# EasyEDA Pro project BCI_nikki_corp_ver_1.0.eprj, schematic BCI_ADS1299 (continued)
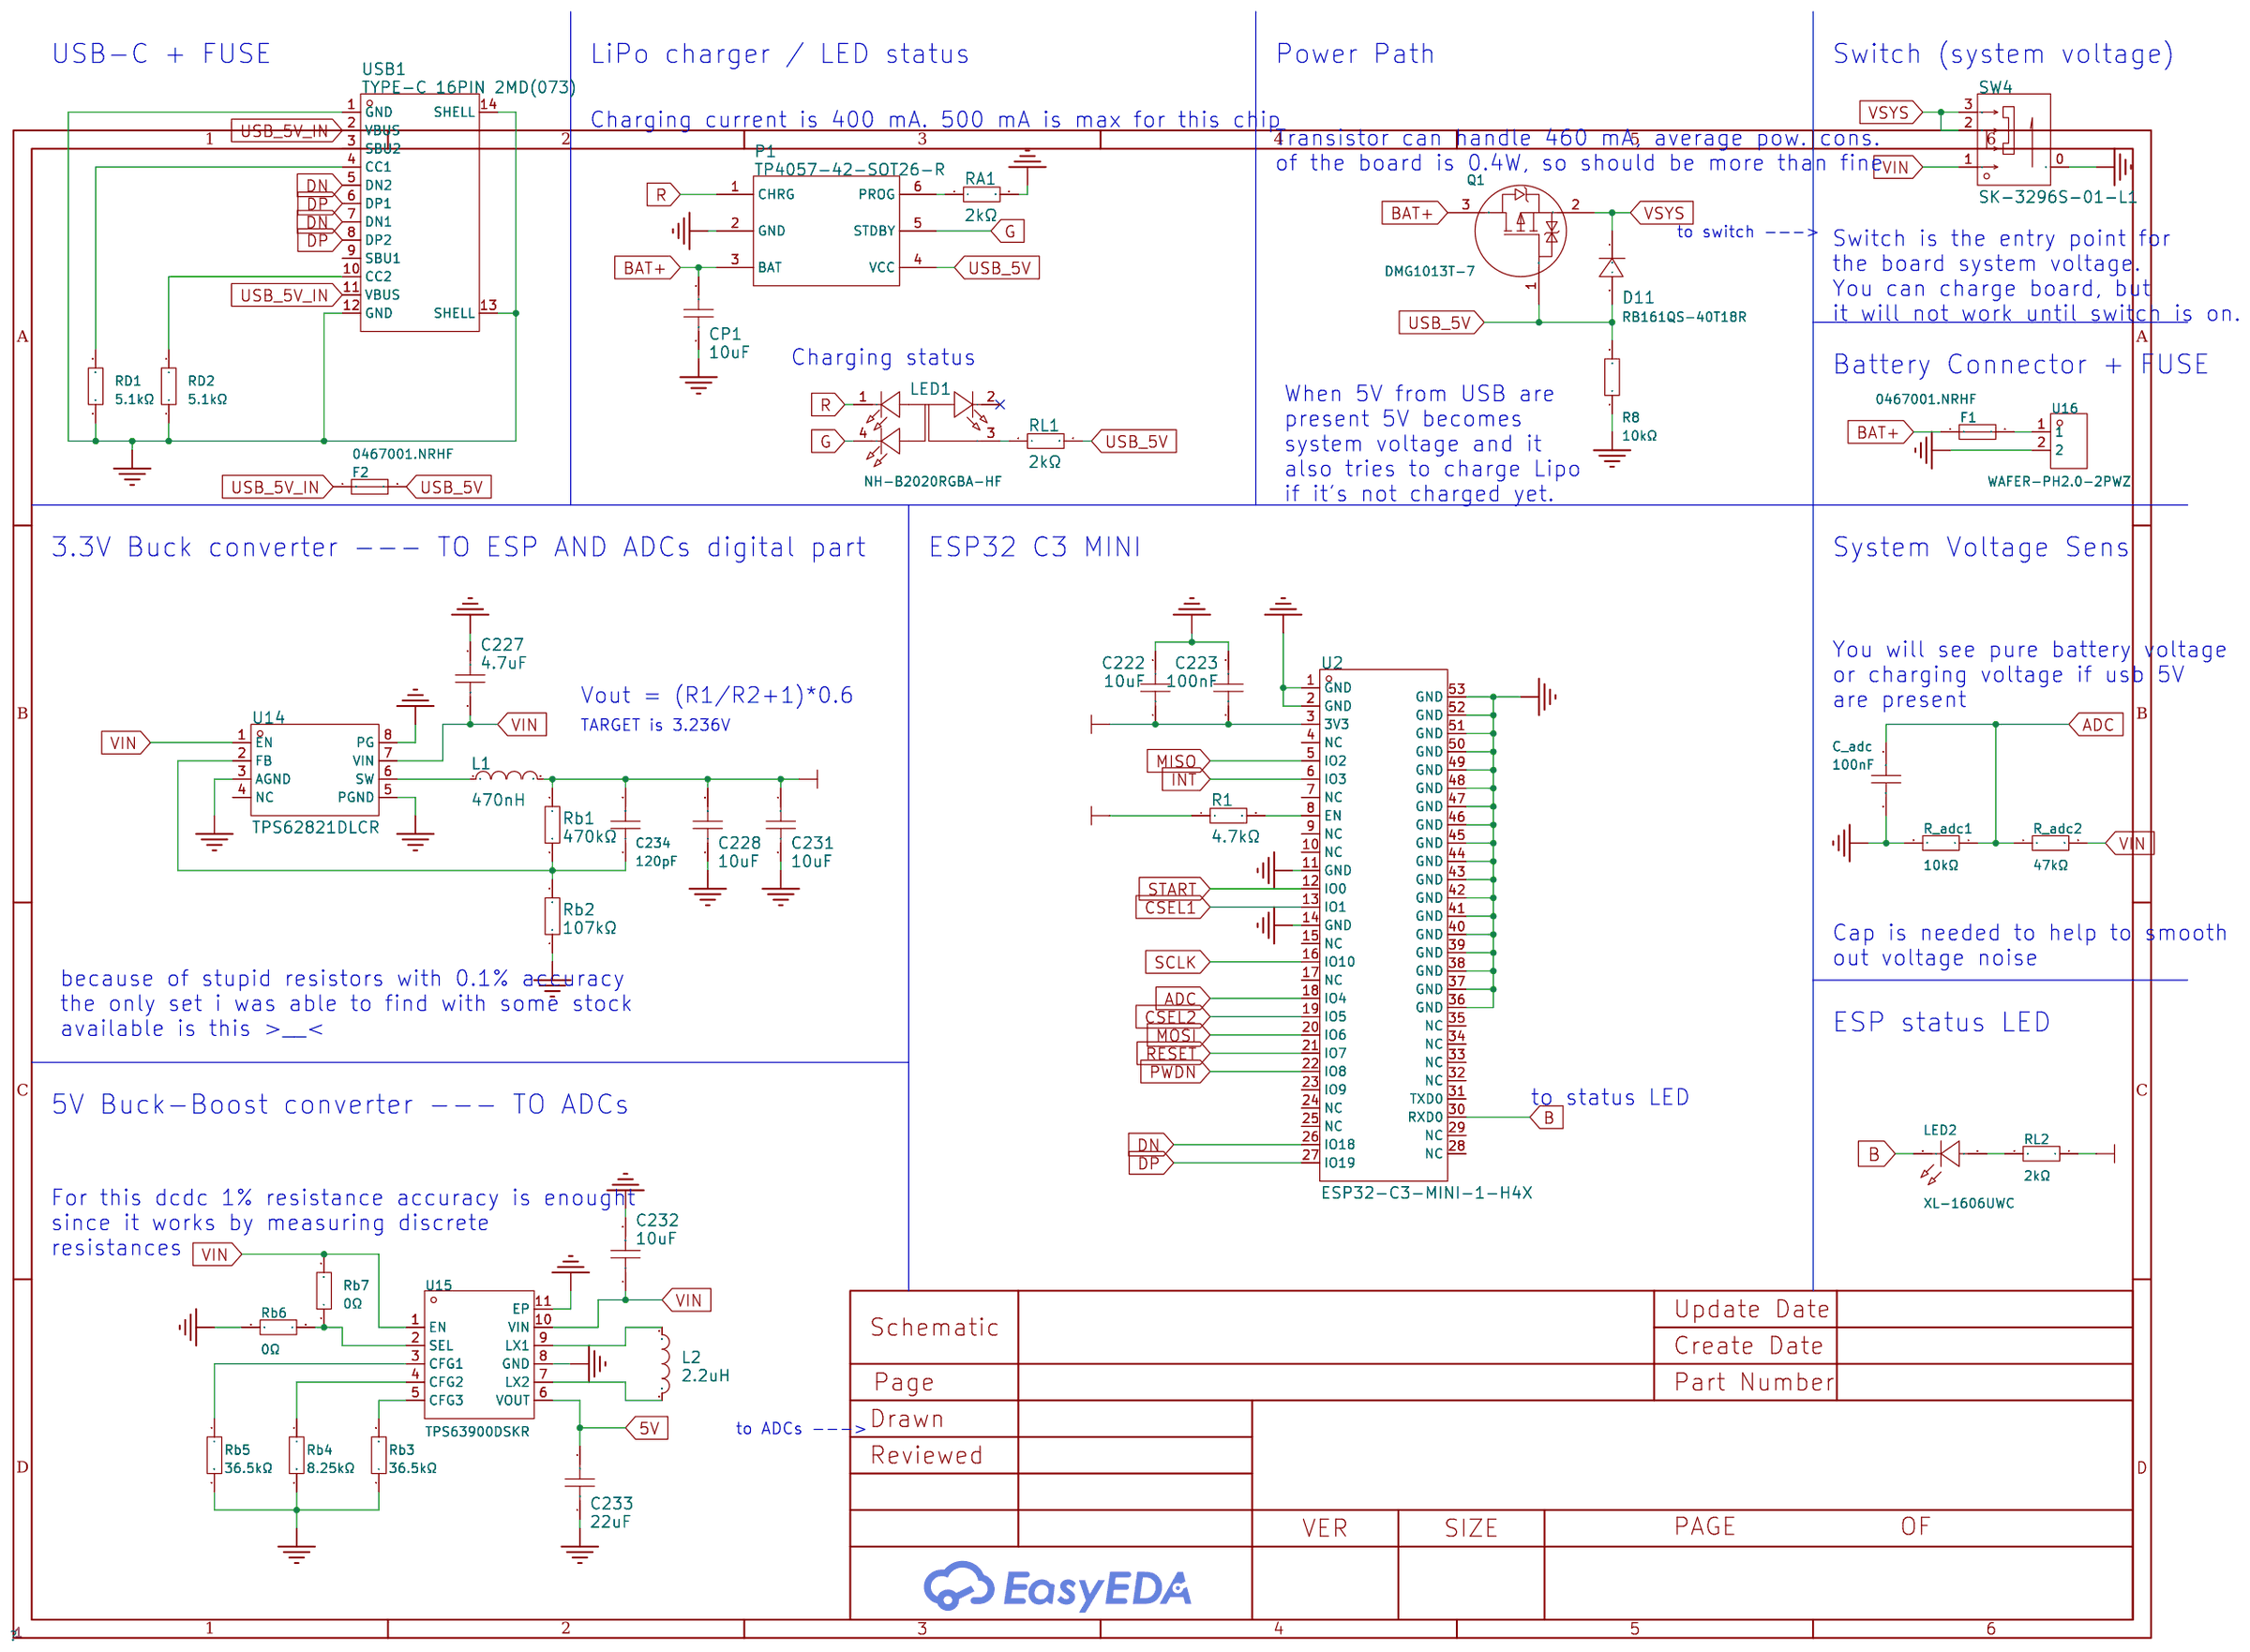
[diagram p0: ESP and Power]
## Library data of the parts
C101-C116 C201-C216 CBIAS1 Csrb11 Csrb12 Csrb21 Csrb22 = GCM155R71H472KA37D: Capacitance: Tolerance:±10% Tolerance:±10% Voltage Rated: Temperature Coefficient:; LCSC Part Name: 4.7nF ±10% 50V; Supplier Part: C85860; Manufacturer: muRata(村田); Supplier Footprint: 0402; JLCPCB Part Class: Extended Part; Datasheet: https://atta.szlcsc.com/upload/public/pdf/source/20161104/1478252919844.pdf; Supplier: LCSC; Tolerance: ±10%
D1-D5 D7-D10 = TPD4E1B06DCKR: Type:ESD; Supplier Part: C840093; Manufacturer: TI(德州仪器); Supplier Footprint: SOT-363; JLCPCB Part Class: Extended Part; Datasheet: https://www.ti.com/cn/lit/gpn/tpd4e1b06; Supplier: LCSC; Type: ESD
H3 = X6521WR-2x18H-C60D30: Pin Structure:2x18P Pitch:2.54mm Row Spacing:2.54mm Circluar Pins/Square Pins:Square Pins Mounting Type:- Number of Rows:双排 Number of Pins:36P Current Rating (Max):3A Voltage Rating (Max):250V Length of Mating Pin:- Insulation Height:2.5mm Length of End C; LCSC Part Name: 2x18P 间距:2.54mm 方针; Supplier Part: C725930; Manufacturer: XKB Connection(中国星坤); Supplier Footprint: 弯插,P=2.54mm; JLCPCB Part Class: Extended Part; Supplier: LCSC; Pin Structure: 2x18P; Pitch: 2.54mm; Row Spacing: 2.54mm; Circluar Pins/Square Pins: Square Pins; Number of Rows: 双排; Number of Pins: 36P; Current Rating (Max): 3A; Voltage Rating (Max): 250V; Insulation Height: 2.5mm; Contact Plating: Gold; Operating Temperature Range: -40℃~+105℃; Soldering Temperature(Max): 260℃; Color: Black
R1 R101-R116 R201-R216 RBIAS5 Rsrb11 Rsrb12 Rsrb21 Rsrb22 = RC0402FR-074K7L: Type:Thick Film Resistors Resistance: Tolerance:±1% Tolerance:±1% Power(Watts): Overload Voltage (Max): Temperature Coefficient:±100ppm/℃ Temperature Coefficient:±100ppm/℃ Operating Temperature Range:-55℃~+155℃ Operating Temperature Range:-55℃~+155℃; LCSC Part Name: 厚膜电阻 4.7kΩ ±1% 62.5mW; Supplier Part: C105871; Manufacturer: YAGEO(国巨); Supplier Footprint: 0402; JLCPCB Part Class: Extended Part; Datasheet: https://atta.szlcsc.com/upload/public/pdf/source/20180821/C275644_0D56F95EFF785E7D9A1FEF436B37DA78.pdf; Supplier: LCSC; Type: Thick Film Resistors; Tolerance: ±1%; Temperature Coefficient: ±100ppm/℃; Operating Temperature Range: -55℃~+155℃
ADC1 ADC2 = ADS1299IPAGR: Supply Voltage:5V；1.8V~3.6V Supply Voltage:5V；1.8V~3.6V; LCSC Part Name: ADS1299-x 低噪声、4/6/8通道、24bit 、同时采样模数转换器，用于EEG和生物电bit 测量; Supplier Part: C476817; Manufacturer: TI(德州仪器); Supplier Footprint: TQFP-64(10x10); JLCPCB Part Class: Extended Part; Datasheet: https://www.ti.com/cn/lit/gpn/ads1299; Supplier: LCSC; Supply Voltage: 5V；1.8V~3.6V
C17 C23 C25 C27 C28 C32 C35-C37 C41 C223 = GRM188R71H104KA93D: Capacitance: Tolerance:±10% Tolerance:±10% Voltage Rated: Temperature Coefficient:; LCSC Part Name: 100nF ±10% 50V; Supplier Part: C77055; Manufacturer: muRata(村田); Supplier Footprint: 0603; JLCPCB Part Class: Extended Part; Datasheet: https://atta.szlcsc.com/upload/public/pdf/source/20200305/C490387_23319AE8C154DEB24C505E6C82A8106A.pdf; Supplier: LCSC; Tolerance: ±10%
C18 C26 C38 C39 C222 = GRM188R61A106KE69D: Capacitance: Tolerance:±10% Tolerance:±10% Voltage Rated: Temperature Coefficient:; LCSC Part Name: 10uF ±10% 10V; Supplier Part: C77044; Manufacturer: muRata(村田); Supplier Footprint: 0603; JLCPCB Part Class: Extended Part; Datasheet: https://atta.szlcsc.com/upload/public/pdf/source/20200305/C490387_23319AE8C154DEB24C505E6C82A8106A.pdf; Supplier: LCSC; Tolerance: ±10%
C19 C20 C22 C24 C29-C31 C34 C40 C42 = GRM188R61E105KA12D: Capacitance: Tolerance:±10% Tolerance:±10% Voltage Rated: Temperature Coefficient:; LCSC Part Name: 1uF ±10% 25V; Supplier Part: C77046; Manufacturer: muRata(村田); Supplier Footprint: 0603; JLCPCB Part Class: Extended Part; Datasheet: https://atta.szlcsc.com/upload/public/pdf/source/20200305/C490387_23319AE8C154DEB24C505E6C82A8106A.pdf; Supplier: LCSC; Tolerance: ±10%
C21 C33 = LMK325BJ107MM-T: Capacitance: Tolerance:±20% Tolerance:±20% Voltage Rated: Temperature Coefficient:; LCSC Part Name: 100uF ±20% 10V; Supplier Part: C92822; Manufacturer: TAIYO YUDEN(太诱); Supplier Footprint: 1210; JLCPCB Part Class: Extended Part; Datasheet: https://atta.szlcsc.com/upload/public/pdf/source/20210525/C2802164_C0429B055888A674C3F00BA74B841C5B.pdf; Supplier: LCSC; Tolerance: ±20%
Cbias3 Cbias4 = GCM155R71H152KA37D: Capacitance: Tolerance:±10% Tolerance:±10% Voltage Rated: Temperature Coefficient:; LCSC Part Name: 1.5nF ±10% 50V; Supplier Part: C126533; Manufacturer: muRata(村田); Supplier Footprint: 0402; JLCPCB Part Class: Extended Part; Datasheet: https://atta.szlcsc.com/upload/public/pdf/source/20170912/C126533_1505207904611963630.pdf; Supplier: LCSC; Tolerance: ±10%
RBIAS1 RBIAS4 = RC0402FR-071ML: Type:Thick Film Resistors Resistance: Tolerance:±1% Tolerance:±1% Power(Watts): Overload Voltage (Max): Temperature Coefficient:±100ppm/℃ Temperature Coefficient:±100ppm/℃ Operating Temperature Range:-55℃~+155℃ Operating Temperature Range:-55℃~+155℃; LCSC Part Name: 厚膜电阻 1MΩ ±1% 62.5mW; Supplier Part: C138033; Manufacturer: YAGEO(国巨); Supplier Footprint: 0402; JLCPCB Part Class: Extended Part; Datasheet: https://atta.szlcsc.com/upload/public/pdf/source/20181009/C309620_DA5935B6E1D48212CB7A533FE518B3C2.pdf; Supplier: LCSC; Type: Thick Film Resistors; Tolerance: ±1%; Temperature Coefficient: ±100ppm/℃; Operating Temperature Range: -55℃~+155℃
C227 = GRM188Z71C475KE21D: Capacitance: Tolerance:±10% Tolerance:±10% Voltage Rated: Temperature Coefficient:; LCSC Part Name: 4.7uF ±10% 16V; Supplier Part: C389010; Manufacturer: muRata(村田); Supplier Footprint: 0603; JLCPCB Part Class: Extended Part; Datasheet: https://atta.szlcsc.com/upload/public/pdf/source/20190418/C389010_378994D96815F6C3A9D8A85630794D48.pdf; Supplier: LCSC; Tolerance: ±10%
C228 C232 = GRM188Z71A106MA73D: Capacitance: Tolerance:±20% Tolerance:±20% Voltage Rated: Temperature Coefficient:; LCSC Part Name: 10uF ±20% 10V; Supplier Part: C237435; Manufacturer: muRata(村田); Supplier Footprint: 0603; JLCPCB Part Class: Extended Part; Datasheet: https://atta.szlcsc.com/upload/public/pdf/source/20181211/C237435_300BF13F81FF0E5C4A93B9033DFC5A9C.pdf; Supplier: LCSC; Tolerance: ±20%
C231 = GRM188Z71A106MA73D: LCSC Part Name: 10uF ±20% 10V; Supplier Part: C237435; Manufacturer: muRata(村田); Supplier Footprint: 0603; JLCPCB Part Class: Extended Part; Datasheet: https://atta.szlcsc.com/upload/public/pdf/source/20181211/C237435_300BF13F81FF0E5C4A93B9033DFC5A9C.pdf; Supplier: LCSC; Tolerance: ±20%
C233 = GRM187R60J226ME15D: LCSC Part Name: 22uF ±20% 6.3V; Supplier Part: C710887; Manufacturer: muRata(村田); Supplier Footprint: 0603; JLCPCB Part Class: Extended Part; Datasheet: https://atta.szlcsc.com/upload/public/pdf/source/20221018/AE33A061041C91F623F47E5EC66E292D.pdf; Supplier: LCSC; Tolerance: ±20%
C234 = GCM1555C1H121JA16D: LCSC Part Name: 120pF ±5% 50V; Supplier Part: C161146; Manufacturer: muRata(村田); Supplier Footprint: 0402; JLCPCB Part Class: Extended Part; Datasheet: https://atta.szlcsc.com/upload/public/pdf/source/20180821/C161146_1B58FA3732A46694B54ED9CFB4C5128D.pdf; Supplier: LCSC; Tolerance: ±5%
C_adc = CL05B104KO5NNNC: Capacitance: Tolerance:±10% Tolerance:±10% Voltage Rated: Temperature Coefficient:; LCSC Part Name: 100nF ±10% 16V; Supplier Part: C1525; Manufacturer: SAMSUNG(三星); Supplier Footprint: 0402; JLCPCB Part Class: Basic Part; Datasheet: https://atta.szlcsc.com/upload/public/pdf/source/20160218/1457707763339.pdf; Supplier: LCSC; Tolerance: ±10%; Voltage Rated: 16V; Temperature Coefficient: X7R
CP1 = CL10A106KP8NNNC: Capacitance: Tolerance:±10% Tolerance:±10% Voltage Rated: Temperature Coefficient:; LCSC Part Name: 10uF ±10% 10V; Supplier Part: C19702; Manufacturer: SAMSUNG(三星); Supplier Footprint: 0603; JLCPCB Part Class: Basic Part; Datasheet: https://atta.szlcsc.com/upload/public/pdf/source/20160218/1457707763339.pdf; Supplier: LCSC; Tolerance: ±10%; link: https://item.szlcsc.com/362304.html; 3DModel: C0603_L1.6-W0.8-H0.8
D11 = RB161QS-40T18R: Diode Configuration:Single Forward Voltage (Vf@If):600mV@1A Reverse Voltage (Vr):40V Average Rectified Current (Io):1A Reverse Leakage Current (Ir):100uA@10V; LCSC Part Name: 电压:40V 电流:1A; Supplier Part: C2837790; Manufacturer: ROHM(罗姆); Supplier Footprint: 0402; JLCPCB Part Class: Extended Part; Datasheet: https://atta.szlcsc.com/upload/public/pdf/source/20211010/C2837790_9DFCE7771C4E041BA4561B652FD916E7.pdf; Supplier: LCSC; Diode Configuration: Single; Forward Voltage (Vf@If): 600mV@1A; Reverse Voltage (Vr): 40V; Average Rectified Current (Io): 1A; Reverse Leakage Current (Ir): 100uA@10V
F1 F2 = 0467001.NRHF: LCSC Part Name: 32V贴片式保险丝; Supplier Part: C151139; Manufacturer: Littelfuse(美国力特); Supplier Footprint: 0603; JLCPCB Part Class: Extended Part; Datasheet: https://atta.szlcsc.com/upload/public/pdf/source/20171201/C151140_15121178500441156397.pdf; Supplier: LCSC; Type: SMD Fuse; Current Rating: 1A; Voltage Rating  (AC): 32V; Voltage Rating (DC): 32V; Operating Temperature: -55℃~+90℃; Breaking Capacity: 50A
L1 = DFE201610E-R47M=P2: Inductance:470nH Tolerance:±20% Tolerance:±20% Current Rating:3.6A Current - Saturation(Isat):4.8A DC Resistance(DCR):32mΩ Ratings:-; LCSC Part Name: 470nH ±20% 4.8A; Supplier Part: C269773; Manufacturer: muRata(村田); Supplier Footprint: 0806; JLCPCB Part Class: Extended Part; Datasheet: https://atta.szlcsc.com/upload/public/pdf/source/20200117/C71648_A73AE086BF8994AAD268F06999EA2D6E.pdf; Supplier: LCSC; Tolerance: ±20%; Current Rating: 3.6A; Current - Saturation(Isat): 4.8A; DC Resistance(DCR): 32mΩ
L2 = DFE252012F-2R2M=P2: LCSC Part Name: 2.2uH ±20% 3.6A; Supplier Part: C576403; Manufacturer: muRata(村田); Supplier Footprint: 1008; JLCPCB Part Class: Extended Part; Datasheet: https://atta.szlcsc.com/upload/public/pdf/source/20200716/C703141_C4AFEA7D31E0931E23F948A8B91A9E18.pdf; Supplier: LCSC; Tolerance: ±20%; Current Rating: 2.3A; Current - Saturation(Isat): 3.6A; DC Resistance(DCR): 82mΩ
LED1 = NH-B2020RGBA-HF: Diode Configuration:Common Anode Dominant Wavelength:G:525nm；R:622nm；B:468nm Luminous Intensity:R:45mcd；G:160mcd；B:25mcd Viewing Angle:110° Forward Current:R:8mA；G:5mA；B:3mA Forward Voltage:R:2V；G:2.7V；B:2.8V Installation Method:Positive Stick Operating T; Supplier Part: C2874116; Manufacturer: 国星光电; Supplier Footprint: SMD,2.1x2.1mm; JLCPCB Part Class: Extended Part; Datasheet: https://atta.szlcsc.com/upload/public/pdf/source/20210810/F2CC95523506BC87574AF0308E7F77A3.pdf; Supplier: LCSC; Diode Configuration: Common Anode; Dominant Wavelength: G:525nm；R:622nm；B:468nm; Luminous Intensity: R:45mcd；G:160mcd；B:25mcd; Viewing Angle: 110°; Forward Current: R:8mA；G:5mA；B:3mA; Forward Voltage: R:2V；G:2.7V；B:2.8V; Installation Method: Positive Stick; Operating Temperature: -30℃~+85℃
LED2 = XL-1606UWC: Lamp Holder Type:- Emitted Color:White Forward Voltage (VF):- Forward Voltage (VF):- Power Dissipation:80mW Forward Current:25mA Dominant Wavelength:- Dominant Wavelength:- Peak Wavelength:- Diode Configuration:- Lens Color:黄色透镜 Color Temperature:- Color; Supplier Part: C965866; Manufacturer: XINGLIGHT(成兴光); Supplier Footprint: SMD,1.1x1.7mm; JLCPCB Part Class: Extended Part; Datasheet: https://atta.szlcsc.com/upload/public/pdf/source/20240218/BC03B579B8AA56D80BCE375E4E5023D6.pdf; Supplier: LCSC; Emitted Color: White; Power Dissipation: 80mW; Forward Current: 25mA; Lens Color: 黄色透镜; Viewing Angle: 120°; Mounting Sytle: Side stickers; Operating Temperature: -30℃~+85℃
P1 = TP4057-42-SOT26-R: LCSC Part Name: TP4057 1%; Supplier Part: C12044; Manufacturer: TOPPOWER(南京拓微); Supplier Footprint: SOT-23-6; JLCPCB Part Class: Extended Part; Datasheet: https://atta.szlcsc.com/upload/public/pdf/source/20140228/1457706997013.pdf; Supplier: LCSC
Q1 = DMG1013T-7: Type:1个PChannel Drain Source Voltage (Vdss): Continuous Drain Current (Id): Power Dissipation (Pd): Drain Source On Resistance (RDS(on)@Vgs,Id):700mΩ@4.5V,350mA Gate Threshold Voltage (Vgs(th)@Id):1V@250uA Total Gate Charge (Qg@Vgs):622pC@4.5V Input Capac; LCSC Part Name: 1个P沟道 耐压:20V 电流:460mA; Supplier Part: C96676; Manufacturer: DIODES(美台); Supplier Footprint: SOT-523; JLCPCB Part Class: Extended Part; Datasheet: https://atta.szlcsc.com/upload/public/pdf/source/20171221/C96676_15138313335161195620.pdf; Supplier: LCSC; Type: 1个PChannel; Drain Source Voltage (Vdss): 20V; Continuous Drain Current (Id): 460mA; Power Dissipation (Pd): 270mW; Drain Source On Resistance (RDS(on)@Vgs,Id): 700mΩ@4.5V,350mA; Gate Threshold Voltage (Vgs(th)@Id): 1V@250uA; Total Gate Charge (Qg@Vgs): 622pC@4.5V; Input Capacitance (Ciss@Vds): 59.76pF@16V; Operating Temperature: -55℃~+150℃@(Tj)
R8 R_adc1 = 0402WGF1002TCE: Type:Thick Film Resistors Resistance:10kΩ Tolerance:±1% Tolerance:±1% Power(Watts): Overload Voltage (Max): Temperature Coefficient:±100ppm/℃ Temperature Coefficient:±100ppm/℃ Operating Temperature Range:-55℃~+155℃ Operating Temperature Range:-55℃~+155℃; LCSC Part Name: 10kΩ ±1% 62.5mW 厚膜电阻; Supplier Part: C25744; Manufacturer: UNI-ROYAL(厚声); Supplier Footprint: 0402; JLCPCB Part Class: Basic Part; Datasheet: https://atta.szlcsc.com/upload/public/pdf/source/20200306/C422600_1E6D84923E4A46A82E41ADD87F860B5C.pdf; Supplier: LCSC; Type: Thick Film Resistors; Tolerance: ±1%; Power(Watts): 62.5mW; Overload Voltage (Max): 50V; Temperature Coefficient: ±100ppm/℃; Operating Temperature Range: -55℃~+155℃
R_adc2 = 0402WGF4702TCE: Type:Thick Film Resistors Resistance:47kΩ Tolerance:±1% Tolerance:±1% Power(Watts): Overload Voltage (Max): Temperature Coefficient:±100ppm/℃ Temperature Coefficient:±100ppm/℃ Operating Temperature Range:-55℃~+155℃ Operating Temperature Range:-55℃~+155℃; LCSC Part Name: 47kΩ ±1% 62.5mW 厚膜电阻; Supplier Part: C25792; Manufacturer: UNI-ROYAL(厚声); Supplier Footprint: 0402; JLCPCB Part Class: Basic Part; Datasheet: https://atta.szlcsc.com/upload/public/pdf/source/20200306/C422600_1E6D84923E4A46A82E41ADD87F860B5C.pdf; Supplier: LCSC; Type: Thick Film Resistors; Tolerance: ±1%; Power(Watts): 62.5mW; Overload Voltage (Max): 50V; Temperature Coefficient: ±100ppm/℃; Operating Temperature Range: -55℃~+155℃
RA1 RL1 RL2 = 0402WGF2001TCE: Type:Thick Film Resistors Resistance:2kΩ Tolerance:±1% Tolerance:±1% Power(Watts): Overload Voltage (Max): Temperature Coefficient:±100ppm/℃ Temperature Coefficient:±100ppm/℃ Operating Temperature Range:-55℃~+155℃ Operating Temperature Range:-55℃~+155℃; LCSC Part Name: 2kΩ ±1% 62.5mW 厚膜电阻; Supplier Part: C4109; Manufacturer: UNI-ROYAL(厚声); Supplier Footprint: 0402; JLCPCB Part Class: Basic Part; Datasheet: https://atta.szlcsc.com/upload/public/pdf/source/20200306/C422600_1E6D84923E4A46A82E41ADD87F860B5C.pdf; Supplier: LCSC; Type: Thick Film Resistors; Tolerance: ±1%; Power(Watts): 62.5mW; Overload Voltage (Max): 50V; Temperature Coefficient: ±100ppm/℃; Operating Temperature Range: -55℃~+155℃
Rb1 = AR02BTC4703: Type:Thin Film Resistor Resistance: Tolerance:±0.1% Tolerance:±0.1% Power(Watts): Overload Voltage (Max): Temperature Coefficient:±25ppm/℃ Temperature Coefficient:±25ppm/℃ Operating Temperature Range:-55℃~+155℃ Operating Temperature Range:-55℃~+155℃; LCSC Part Name: 薄膜电阻 470kΩ ±0.1% 62.5mW; Supplier Part: C319591; Manufacturer: Viking(光颉); Supplier Footprint: 0402; JLCPCB Part Class: Extended Part; Datasheet: https://atta.szlcsc.com/upload/public/pdf/source/20191129/C465721_10D49275DB41E427863CE9C8D788770A.pdf; Supplier: LCSC; Type: Thin Film Resistor; Tolerance: ±0.1%; Temperature Coefficient: ±25ppm/℃; Operating Temperature Range: -55℃~+155℃
Rb2 = RT0402BRD07100KL: Type:Thin Film Resistor Resistance: Tolerance:±0.1% Tolerance:±0.1% Power(Watts): Overload Voltage (Max): Temperature Coefficient:±25ppm/℃ Temperature Coefficient:±25ppm/℃ Operating Temperature Range:-55℃~+155℃ Operating Temperature Range:-55℃~+155℃; LCSC Part Name: 薄膜电阻 100kΩ ±0.1% 62.5mW; Supplier Part: C852472; Manufacturer: YAGEO(国巨); Manufacturer Part: RT0402BRD07107KL; Supplier Footprint: 0402; JLCPCB Part Class: Extended Part; Datasheet: https://atta.szlcsc.com/upload/public/pdf/source/20210326/C852472_6283D268A9C33EA67274729CC55E28B1.pdf; Supplier: LCSC; Type: Thin Film Resistor; Tolerance: ±0.1%; Temperature Coefficient: ±25ppm/℃; Operating Temperature Range: -55℃~+155℃
Rb3 Rb5 = RC0402FR-0736K5L: LCSC Part Name: 厚膜电阻 36.5kΩ ±1% 62.5mW; Supplier Part: C15011; Manufacturer: YAGEO(国巨); Supplier Footprint: 0402; JLCPCB Part Class: Extended Part; Datasheet: https://atta.szlcsc.com/upload/public/pdf/source/20170925/C131467_1506321478108990263.pdf; Supplier: LCSC; Type: Thick Film Resistors; Tolerance: ±1%; Temperature Coefficient: ±100ppm/℃; Operating Temperature Range: -55℃~+155℃
Rb4 = RC0402FR-078K25L: Type:Thick Film Resistors Resistance: Tolerance:±1% Tolerance:±1% Power(Watts): Overload Voltage (Max): Temperature Coefficient:±100ppm/℃ Temperature Coefficient:±100ppm/℃ Operating Temperature Range:-55℃~+155℃ Operating Temperature Range:-55℃~+155℃; LCSC Part Name: 厚膜电阻 8.25kΩ ±1% 62.5mW; Supplier Part: C185389; Manufacturer: YAGEO(国巨); Supplier Footprint: 0402; JLCPCB Part Class: Extended Part; Datasheet: https://atta.szlcsc.com/upload/public/pdf/source/20180904/C276339_014E484F1DBA106FB92D45EABD5A1AC1.pdf; Supplier: LCSC; Type: Thick Film Resistors; Tolerance: ±1%; Temperature Coefficient: ±100ppm/℃; Operating Temperature Range: -55℃~+155℃
Rb6 = 0402WGF0000TCE: Type:Thick Film Resistors Resistance: Tolerance:±1% Tolerance:±1% Power(Watts): Overload Voltage (Max): Temperature Coefficient:±800ppm/℃ Temperature Coefficient:±800ppm/℃ Operating Temperature Range:-55℃~+155℃ Operating Temperature Range:-55℃~+155℃; LCSC Part Name: 0Ω ±1% 62.5mW 厚膜电阻; Supplier Part: C17168; Manufacturer: UNI-ROYAL(厚声); Supplier Footprint: 0402; JLCPCB Part Class: Basic Part; Datasheet: https://atta.szlcsc.com/upload/public/pdf/source/20200306/C422600_1E6D84923E4A46A82E41ADD87F860B5C.pdf; Supplier: LCSC; Type: Thick Film Resistors; Tolerance: ±1%; Temperature Coefficient: ±800ppm/℃; Operating Temperature Range: -55℃~+155℃
Rb7 = RC0402FR-070RL: LCSC Part Name: 厚膜电阻 0Ω ±1% 62.5mW; Supplier Part: C106231; Manufacturer: YAGEO(国巨); Supplier Footprint: 0402; JLCPCB Part Class: Extended Part; Datasheet: https://atta.szlcsc.com/upload/public/pdf/source/20180927/C295883_E8D83085EA81BD7DE0B2B681138C15EE.pdf; Supplier: LCSC; Type: Thick Film Resistors; Tolerance: ±1%; Operating Temperature Range: -55℃~+155℃
RD1 RD2 = 0402WGF5101TCE: Type:Thick Film Resistors Resistance:5.1kΩ Tolerance:±1% Tolerance:±1% Power(Watts): Overload Voltage (Max): Temperature Coefficient:±100ppm/℃ Temperature Coefficient:±100ppm/℃ Operating Temperature Range:-55℃~+155℃ Operating Temperature Range:-55℃~+155℃; LCSC Part Name: 5.1kΩ ±1% 62.5mW 厚膜电阻; Supplier Part: C25905; Manufacturer: UNI-ROYAL(厚声); Supplier Footprint: 0402; JLCPCB Part Class: Basic Part; Datasheet: https://atta.szlcsc.com/upload/public/pdf/source/20200306/C422600_1E6D84923E4A46A82E41ADD87F860B5C.pdf; Supplier: LCSC; Type: Thick Film Resistors; Tolerance: ±1%; Power(Watts): 62.5mW; Overload Voltage (Max): 50V; Temperature Coefficient: ±100ppm/℃; Operating Temperature Range: -55℃~+155℃
SW4 = SK-3296S-01-L1: Circuit:SPDT Actuator Style:Rectangular columnar Pin Style:SMDSplicing Switch Length:7.8mm Switch Width:2.75mm Switch Height:1.35mm Mounting Style:卧贴 Actuator Color:Black Current Rating (DC):50mA Voltage Rating (DC):12V Current Rating (AC):50mA Voltage Ra; LCSC Part Name: 柄长1.5mm 卧贴双档 滑动开关; Supplier Part: C319020; Manufacturer: XKB Connectivity(中国星坤); Supplier Footprint: SMD; JLCPCB Part Class: Extended Part; Datasheet: https://atta.szlcsc.com/upload/public/pdf/source/20211011/33977E7F5E3AE40A3E3DC6795807E20F.pdf; Supplier: LCSC; Circuit: SPDT; Actuator Style: Rectangular columnar; Pin Style: SMDSplicing; Switch Length: 7.8mm; Switch Width: 2.75mm; Switch Height: 1.35mm; Mounting Style: 卧贴; Actuator Color: Black; Current Rating (DC): 50mA; Voltage Rating (DC): 12V; Current Rating (AC): 50mA; Voltage Rating (AC): 12V; Mechanical Life: 1万次; Operating Temperature: -40℃~+85℃
U2 = ESP32-C3-MINI-1-H4X: Supplier Part: C41349510; Manufacturer: ESPRESSIF(乐鑫); Supplier Footprint: SMD,13.2x16.6mm; JLCPCB Part Class: Extended Part; Datasheet: https://atta.szlcsc.com/upload/public/pdf/source/20241205/24CE24F9A05631C779B86A1094185BBE.pdf; Supplier: LCSC
U14 = TPS62821DLCR: Supplier Part: C469860; Manufacturer: TI(德州仪器); Supplier Footprint: VSON-8(1.5x2); JLCPCB Part Class: Extended Part; Datasheet: https://www.ti.com/cn/lit/gpn/tps62821; Supplier: LCSC; Function: Step-down type; Switch tube (built-in/external): 内置
U15 = TPS63900DSKR: LCSC Part Name: 1.8V至5.5V,75nA超低静态电流同步升降压转换器; Supplier Part: C1518762; Manufacturer: TI(德州仪器); Supplier Footprint: WSON-10-EP(2.5x2.5); JLCPCB Part Class: Extended Part; Datasheet: https://www.ti.com/cn/lit/gpn/tps63900; Supplier: LCSC; Input Voltage: 1.8V~5.5V; Output Current: 400mA; Operating Temperature: -40℃~+125℃@(TJ); Synchronous Rectification: Yes; Topology: Step-down-Boost
U16 = WAFER-PH2.0-2PWZ: LCSC Part Name: 1x2P 间距:2mm 弯插 系列:PH; Supplier Part: C5359610; Manufacturer: XUNPU(讯普); Supplier Footprint: 弯插,P=2mm; JLCPCB Part Class: Extended Part; Datasheet: https://atta.szlcsc.com/upload/public/pdf/source/20230728/47B07572F36CD4F6F91BE29B817CECA3.pdf; Supplier: LCSC; Pins Structure: 1x2P; Pitch: 2mm; Mounting Type: Bend-in; Reference Series: PH; Number of Pins: 2P; Number of Rows: 1; Number of PINs Per Row: 2; Current Rating: 2A; Contact Material: Brass; Contact Plating: Tin; Operating Temperature: -25℃~+85℃; Voltage Rating: 250V; Plastic Material: PA66; Flame Retardant Rating: UL94V-0; Color: White; Z-Height of the Board: 4.7mm; X-Length of Bottom Edge on Board (Spacing Line): 6mm; Y-Width of Bottom Edge on Board: 6.05mm
USB1 = TYPE-C 16PIN 2MD(073): Connector Type:Type-C Standard:USB 3.1 Gender:Female Mounting Style:Horizontal attachment Number of Contacts:16P Number of Ports:1 Current Rating - Power (Max):5A Operating Temperature Range:-25℃~+85℃ Operating Temperature Range:-25℃~+85℃ Rated Voltage (M; LCSC Part Name: Type-C 母 卧贴; Supplier Part: C2765186; Manufacturer: SHOU HAN(首韩); Supplier Footprint: SMD; JLCPCB Part Class: Extended Part; Datasheet: https://atta.szlcsc.com/upload/public/pdf/source/20211123/39B17C16241EAC15C5E277BDA434118E.pdf; Supplier: LCSC; Connector Type: Type-C; Standard: USB 3.1; Gender: Female; Mounting Style: Horizontal attachment; Number of Contacts: 16P; Number of Ports: 1; Current Rating - Power (Max): 5A; Operating Temperature Range: -25℃~+85℃; Rated Voltage (Max): 5V; Connect-Disconnect Life: 5000 Cuts; Core Colour: Black

## Nets
3V3: ADC1.48(DVDD) ADC1.50(DVDD) ADC1.52(CLKSEL) ADC2.48(DVDD) ADC2.50(DVDD) C28.2 C29.2 C41.2 C42.2 C222.1 C223.1 C228.2 C231.1 C234.2 L1.2 R1.1 Rb1.1 RL2.1 U2.3(3V3)
5V: ADC1.19(AVDD) ADC1.21(AVDD) ADC1.22(AVDD) ADC1.54(AVDD1) ADC1.56(AVDD) ADC1.59(AVDD) ADC2.19(AVDD) ADC2.21(AVDD) ADC2.22(AVDD) ADC2.54(AVDD1) ADC2.56(AVDD) ADC2.59(AVDD) C24.2 C25.2 C26.2 C27.2 C36.2 C37.2 C39.2 C40.2 C233.2 U15.6(VOUT)
GND: ADC1.20(AVSS) ADC1.23(AVSS) ADC1.25(VREFN) ADC1.31(RESV1) ADC1.32(AVSS) ADC1.33(DGND) ADC1.49(DGND) ADC1.51(DGND) ADC1.53(AVSS1) ADC1.57(AVSS) ADC1.58(AVSS) ADC1.60(BIASREF) ADC2.20(AVSS) ADC2.23(AVSS) ADC2.25(VREFN) ADC2.31(RESV1) ADC2.32(AVSS) ADC2.33(DGND) ADC2.41(DAISY_IN) ADC2.49(DGND) ADC2.51(DGND) ADC2.52(CLKSEL) ADC2.53(AVSS1) ADC2.57(AVSS) ADC2.58(AVSS) ADC2.60(BIASREF) C17.1 C18.1 C19.2 C20.1 C21.2 C22.2 C23.2 C24.1 C25.1 C26.1 C27.1 C28.1 C29.1 C30.1 C31.2 C32.1 C33.2 C34.2 C35.2 C36.1 C37.1 C38.1 C39.1 C40.1 C41.1 C42.1 C101.2 C102.1 C103.2 C104.1 C105.2 C106.1 C107.2 C108.1 C109.2 C110.1 C111.2 C112.1 C113.2 C114.1 C115.2 C116.1 C201.2 C202.1 C203.2 C204.1 C205.2 C206.1 C207.2 C208.1 C209.2 C210.1 C211.2 C212.1 C213.2 C214.1 C215.2 C216.1 C222.2 C223.2 C227.1 C228.1 C231.2 C232.2 C233.1 C_adc.2 CBIAS1.1 CP1.1 Csrb11.1 Csrb12.2 Csrb21.1 Csrb22.2 D1.3(GND) D2.3(GND) D3.3(GND) D4.3(GND) D5.3(GND) D7.3(GND) D8.3(GND) D9.3(GND) D10.3(GND) P1.2(GND) R8.1 R_adc1.2 RA1.2 Rb2.1 Rb3.1 Rb4.2 Rb5.2 Rb6.1 RD1.1 RD2.1 SW4.0 U2.1(GND) U2.2(GND) U2.11(GND) U2.14(GND) U2.36(GND) U2.37(GND) U2.38(GND) U2.39(GND) U2.40(GND) U2.41(GND) U2.42(GND) U2.43(GND) U2.44(GND) U2.45(GND) U2.46(GND) U2.47(GND) U2.48(GND) U2.49(GND) U2.50(GND) U2.51(GND) U2.52(GND) U2.53(GND) U14.3(AGND) U14.5(PGND) U14.8(PG) U15.8(GND) U15.11(EP) U16.2 USB1.1(GND) USB1.12(GND) USB1.13(SHELL) USB1.14(SHELL)
VIN: C227.2 C232.1 R_adc2.2 Rb7.2 SW4.1 U14.1(EN) U14.7(VIN) U15.1(EN) U15.10(VIN)
ADC: C_adc.1 R_adc1.1 R_adc2.1 U2.18(IO4)
B: LED2.1(K) U2.30(RXD0)
BAT+: CP1.2 F1.1 P1.3(BAT) Q1.3(D)
BIAS_DRV: CBIAS1.2 Cbias3.1 RBIAS4.2 RBIAS5.2
BIASINV: ADC1.61(BIASINV) ADC2.61(BIASINV) Cbias4.2 RBIAS1.2
CLK: ADC1.37(CLK) ADC2.37(CLK)
CSEL1: ADC1.39(CS#) U2.13(IO1)
CSEL2: ADC2.39(CS#) U2.19(IO5)
DN: U2.26(IO18) USB1.5(DN2) USB1.7(DN1)
DP: U2.27(IO19) USB1.6(DP1) USB1.8(DP2)
G: LED1.4(-) P1.5(STDBY)
IN1N: ADC1.15(IN1N) C102.2 R102.2
IN1N1: ADC2.15(IN1N) C202.2 R202.2
IN1P: ADC1.16(IN1P) C101.1 R101.2
IN1P1: ADC2.16(IN1P) C201.1 R201.2
IN2N: ADC1.13(IN2N) C104.2 R104.2
IN2N1: ADC2.13(IN2N) C204.2 R204.2
IN2P: ADC1.14(IN2P) C103.1 R103.2
IN2P1: ADC2.14(IN2P) C203.1 R203.2
IN3N: ADC1.11(IN3N) C106.2 R106.2
IN3N1: ADC2.11(IN3N) C206.2 R206.2
IN3P: ADC1.12(IN3P) C105.1 R105.2
IN3P1: ADC2.12(IN3P) C205.1 R205.2
IN4N: ADC1.9(IN4N) C108.2 R108.2
IN4N1: ADC2.9(IN4N) C208.2 R208.2
IN4P: ADC1.10(IN4P) C107.1 R107.2
IN4P1: ADC2.10(IN4P) C207.1 R207.2
IN5N: ADC1.7(IN5N) C110.2 R110.2
IN5N1: ADC2.7(IN5N) C210.2 R210.2
IN5P: ADC1.8(IN5P) C109.1 R109.2
IN5P1: ADC2.8(IN5P) C209.1 R209.2
IN6N: ADC1.5(IN6N) C112.2 R112.2
IN6N1: ADC2.5(IN6N) C212.2 R212.2
IN6P: ADC1.6(IN6P) C111.1 R111.2
IN6P1: ADC2.6(IN6P) C211.1 R211.2
IN7N: ADC1.3(IN7N) C114.2 R114.2
IN7N1: ADC2.3(IN7N) C214.2 R214.2
IN7P: ADC1.4(IN7P) C113.1 R113.2
IN7P1: ADC2.4(IN7P) C213.1 R213.2
IN8N: ADC1.1(IN8N) C116.2 R116.2
IN8N1: ADC2.1(IN8N) C216.2 R216.2
IN8P: ADC1.2(IN8P) C115.1 R115.2
IN8P1: ADC2.2(IN8P) C215.1 R215.2
INT: ADC1.47(DRDY#) U2.6(IO3)
MISO: ADC1.43(DOUT) U2.5(IO2)
MOSI: ADC1.34(DIN) ADC2.34(DIN) U2.20(IO6)
PBIAS: D5.1(IO1) H3.1 H3.2 RBIAS5.1
PIN1N: D1.1(IO1) H3.17 R102.1
PIN1N1: D7.5(IO4) H3.35 R202.1
PIN1P: D1.2(IO2) H3.18 R101.1
PIN1P1: D7.4(IO3) H3.36 R201.1
PIN2N: D2.5(IO4) H3.15 R104.1
PIN2N1: D7.1(IO1) H3.33 R204.1
PIN2P: D2.4(IO3) H3.16 R103.1
PIN2P1: D7.2(IO2) H3.34 R203.1
PIN3N: D2.1(IO1) H3.13 R106.1
PIN3N1: D8.5(IO4) H3.31 R206.1
PIN3P: D2.2(IO2) H3.14 R105.1
PIN3P1: D8.4(IO3) H3.32 R205.1
PIN4N: D3.5(IO4) H3.11 R108.1
PIN4N1: D8.1(IO1) H3.29 R208.1
PIN4P: D3.4(IO3) H3.12 R107.1
PIN4P1: D8.2(IO2) H3.30 R207.1
PIN5N: D3.1(IO1) H3.9 R110.1
PIN5N1: D9.5(IO4) H3.27 R210.1
PIN5P: D3.2(IO2) H3.10 R109.1
PIN5P1: D9.4(IO3) H3.28 R209.1
PIN6N: D4.5(IO4) H3.7 R112.1
PIN6N1: D9.1(IO1) H3.25 R212.1
PIN6P: D4.4(IO3) H3.8 R111.1
PIN6P1: D9.2(IO2) H3.26 R211.1
PIN7N: D4.1(IO1) H3.5 R114.1
PIN7N1: D10.5(IO4) H3.23 R214.1
PIN7P: D4.2(IO2) H3.6 R113.1
PIN7P1: D10.4(IO3) H3.24 R213.1
PIN8N: D5.5(IO4) H3.3 R116.1
PIN8N1: D10.1(IO1) H3.21 R216.1
PIN8P: D5.4(IO3) H3.4 R115.1
PIN8P1: D10.2(IO2) H3.22 R215.1
PINSRB1: D1.4(IO3) H3.20 Rsrb11.1 Rsrb21.1
PINSRB2: D1.5(IO4) H3.19 Rsrb12.1 Rsrb22.1
PWDN: ADC1.35(PWDN#) ADC2.35(PWDN#) U2.22(IO8)
R: LED1.1(-) P1.1(CHRG)
RESET: ADC1.36(RESET#) ADC2.36(RESET#) U2.21(IO7)
SCLK: ADC1.40(SCLK) ADC2.40(SCLK) U2.16(IO10)
SLAVE_DOUT: ADC1.41(DAISY_IN) ADC2.43(DOUT)
SRB1: ADC1.17(SRB1) Csrb11.2 Rsrb11.2
SRB2: ADC1.18(SRB2) Csrb12.1 Rsrb12.2
SRB11: ADC2.17(SRB1) Csrb21.2 Rsrb21.2
SRB21: ADC2.18(SRB2) Csrb22.1 Rsrb22.2
START: ADC1.38(START) ADC2.38(START) U2.12(IO0)
USB_5V: D11.2(A) F2.2 P1.4(VCC) Q1.1(G) R8.2 RL1.2
USB_5V_IN: F2.1 USB1.2(VBUS) USB1.11(VBUS)
VREFP: ADC1.24(VREFP) C17.2 C18.2
VREFP1: ADC2.24(VREFP) C32.2 C38.2
VSYS: D11.1(C) Q1.2(S) SW4.2 SW4.3
Net-(ADC1-26): ADC1.26(VCAP4) C19.1
Net-(ADC1-28): ADC1.28(VCAP1) C21.1
Net-(ADC1-30): ADC1.30(VCAP2) C20.2
Net-(ADC1-55): ADC1.55(VCAP3) C22.1 C23.1
Net-(ADC1-62): ADC1.62(BIASIN) ADC1.63(BIASOUT) Cbias3.2 Cbias4.1 RBIAS1.1 RBIAS4.1
Net-(ADC2-26): ADC2.26(VCAP4) C31.1
Net-(ADC2-28): ADC2.28(VCAP1) C33.1
Net-(ADC2-30): ADC2.30(VCAP2) C30.2
Net-(ADC2-55): ADC2.55(VCAP3) C34.1 C35.1
Net-(C234-1): C234.1 Rb1.2 Rb2.2 U14.2(FB)
Net-(F1-2): F1.2 U16.1
Net-(L1-1): L1.1 U14.6(SW)
Net-(L2-1): L2.1 U15.9(LX1)
Net-(L2-2): L2.2 U15.7(LX2)
Net-(LED1-3): LED1.3(+) RL1.1
Net-(LED2-2): LED2.2(A) RL2.2
Net-(P1-6): P1.6(PROG) RA1.1
Net-(R1-2): R1.2 U2.8(EN)
Net-(Rb3-2): Rb3.2 U15.5(CFG3)
Net-(Rb4-1): Rb4.1 U15.4(CFG2)
Net-(Rb5-1): Rb5.1 U15.3(CFG1)
Net-(Rb6-2): Rb6.2 Rb7.1 U15.2(SEL)
Net-(RD1-2): RD1.2 USB1.4(CC1)
Net-(RD2-2): RD2.2 USB1.10(CC2)

Not connected (* = marked no-connect by the designer): ADC1 27(NC) 29(NC) 42(GPIO1) 44(GPIO2) 45(GPIO3) 46(GPIO4) 64(RESERVED); ADC2 27(NC) 29(NC) 42(GPIO1) 44(GPIO2) 45(GPIO3) 46(GPIO4) 47(DRDY#) 62(BIASIN) 63(BIASOUT) 64(RESERVED); D1 6(NC); D2 6(NC); D3 6(NC); D4 6(NC); D5 2(IO2) 6(NC); D7 6(NC); D8 6(NC); D9 6(NC); D10 6(NC); LED1 2(-)*; U2 4(NC) 7(NC) 9(NC) 10(NC) 15(NC) 17(NC) 23(IO9) 24(NC) 25(NC) 28(NC) 29(NC) 31(TXD0) 32(NC) 33(NC) 34(NC) 35(NC); U14 4(NC); USB1 3(SBU2) 9(SBU1)

## Notes on the sheets
sheet 1
- USB-C + FUSE
- LiPo charger / LED status
- Power Path
- Switch (system voltage)
- Charging current is 400 mA. 500 mA is max for this chip
- Transistor can handle 460 mA, average pow. cons.
  of the board is 0.4W, so should be more than fine
- Switch is the entry point for
  the board system voltage.
  You can charge board, but
  it will not work until switch is on.
- to switch --->
- Charging status
- When 5V from USB are
  present 5V becomes
  system voltage and it
  also tries to charge Lipo
  if it's not charged yet.
- Battery Connector + FUSE
- 3.3V Buck converter --- TO ESP AND ADCs digital part
- ESP32 C3 MINI
- System Voltage Sens
- You will see pure battery voltage
  or charging voltage if usb 5V
  are present
- Vout = (R1/R2+1)*0.6
- TARGET is 3.236V
- Cap is needed to help to smooth
  out voltage noise
- because of stupid resistors with 0.1% accuracy
  the only set i was able to find with some stock
  available is this >__<
- ESP status LED
- 5V Buck-Boost converter --- TO ADCs
- to status LED
- For this dcdc 1% resistance accuracy is enought
  since it works by measuring discrete
  resistances
- to ADCs --->
sheet 2
- RANDOM KNOWLEDGE
- Hi Mojtaba,
  I'll try to be more clear.
  Q: in total what does the BIASIN pin do and whats it's role?
  A: In the event that the BIAS electrode becomes disconnected from the patient,
  by having BIASOUT connected to BIASIIN, the BIASOUT signal can be routed through
  BIASIN and back to the patient through one of the input electrodes. This way, the patient
  stays biased and the measurements stay within the common-mode input range of the PGA.
  Of course, one measurement will be "lost" since it's being used to bias the patient.
  Q: it should be done in both cascade or daisy chain mode or it's just for daisy chain?
  A: it's the same for both modes.
- This is a very interesting problem! Let me first explain what the SRB
  pins do and what the BIAS pin does. The SRB pins are essentially inputs
  for a reference input that you intend to connect to multiple channels.
  The SRB2 pin can be connected to individual channels' positive inputs.
  The SRB1 pin can be connected to all channels' negative inputs.
  The BIAS pin is the equivalent of a right-leg driver for an ECG measurement.
  It will output a signal that attempts to keep the patient's common-mode
  voltage within the valid range for the ADC.
  This datasheet was actually just updated with a helpful section that discusses
  the various functions of these pins. You can find it here starting on page 65.
  In your case, though, since it is intended to be so modular, I recommend
  you simply connect all INxN inputs to analog ground (assuming you are
  using bipolar supplies) and find each electrode voltage in a single-ended
  fashion. Then you can average each sample to calculate a "reference voltage" to then analyze each individual channel.
- BIASOUT and BIASIN are shorted, because BIASIN is going
  towards mux right away. So as i understood if BIASIN is off
  MUX will not use BIAS voltage to shift signal from 0 to
  as i undestood positive AVDD/2. For unipolar powering AVSS
  is equal to 0 and it means it's just GROUND.
  Check 9.2 Functional Block Diagram for BIASIN
- FOR UNIPOLAR POWERING SCHEME
  AVSS IS 0 - BASICALY GND
  AS WELL AS DIGITAL GROUND
- It;'s important to keep decoupling capacitors
  for all power pins. You can combine several pins
  ino one decoupling capacitor output if they are supa
  close to eachother.
  But in general - Datasheet says to have decopling cap
  for all of them - 1uf and 0.1uF
- here clockselect is DVDD
  to have it set to one to
  have it later as CLK output
  for secondary ADC
sheet 3
- 4.7 kOhm and 4.7nF are from TI evaluaion board datasheet.
  They provide beter filtering of high frequency than having
  lower resistance and capacitance.
